# EasyEDA Pro project ProProject_Avaota Pi A_2024-03-25.epro, board 点位 (continued)
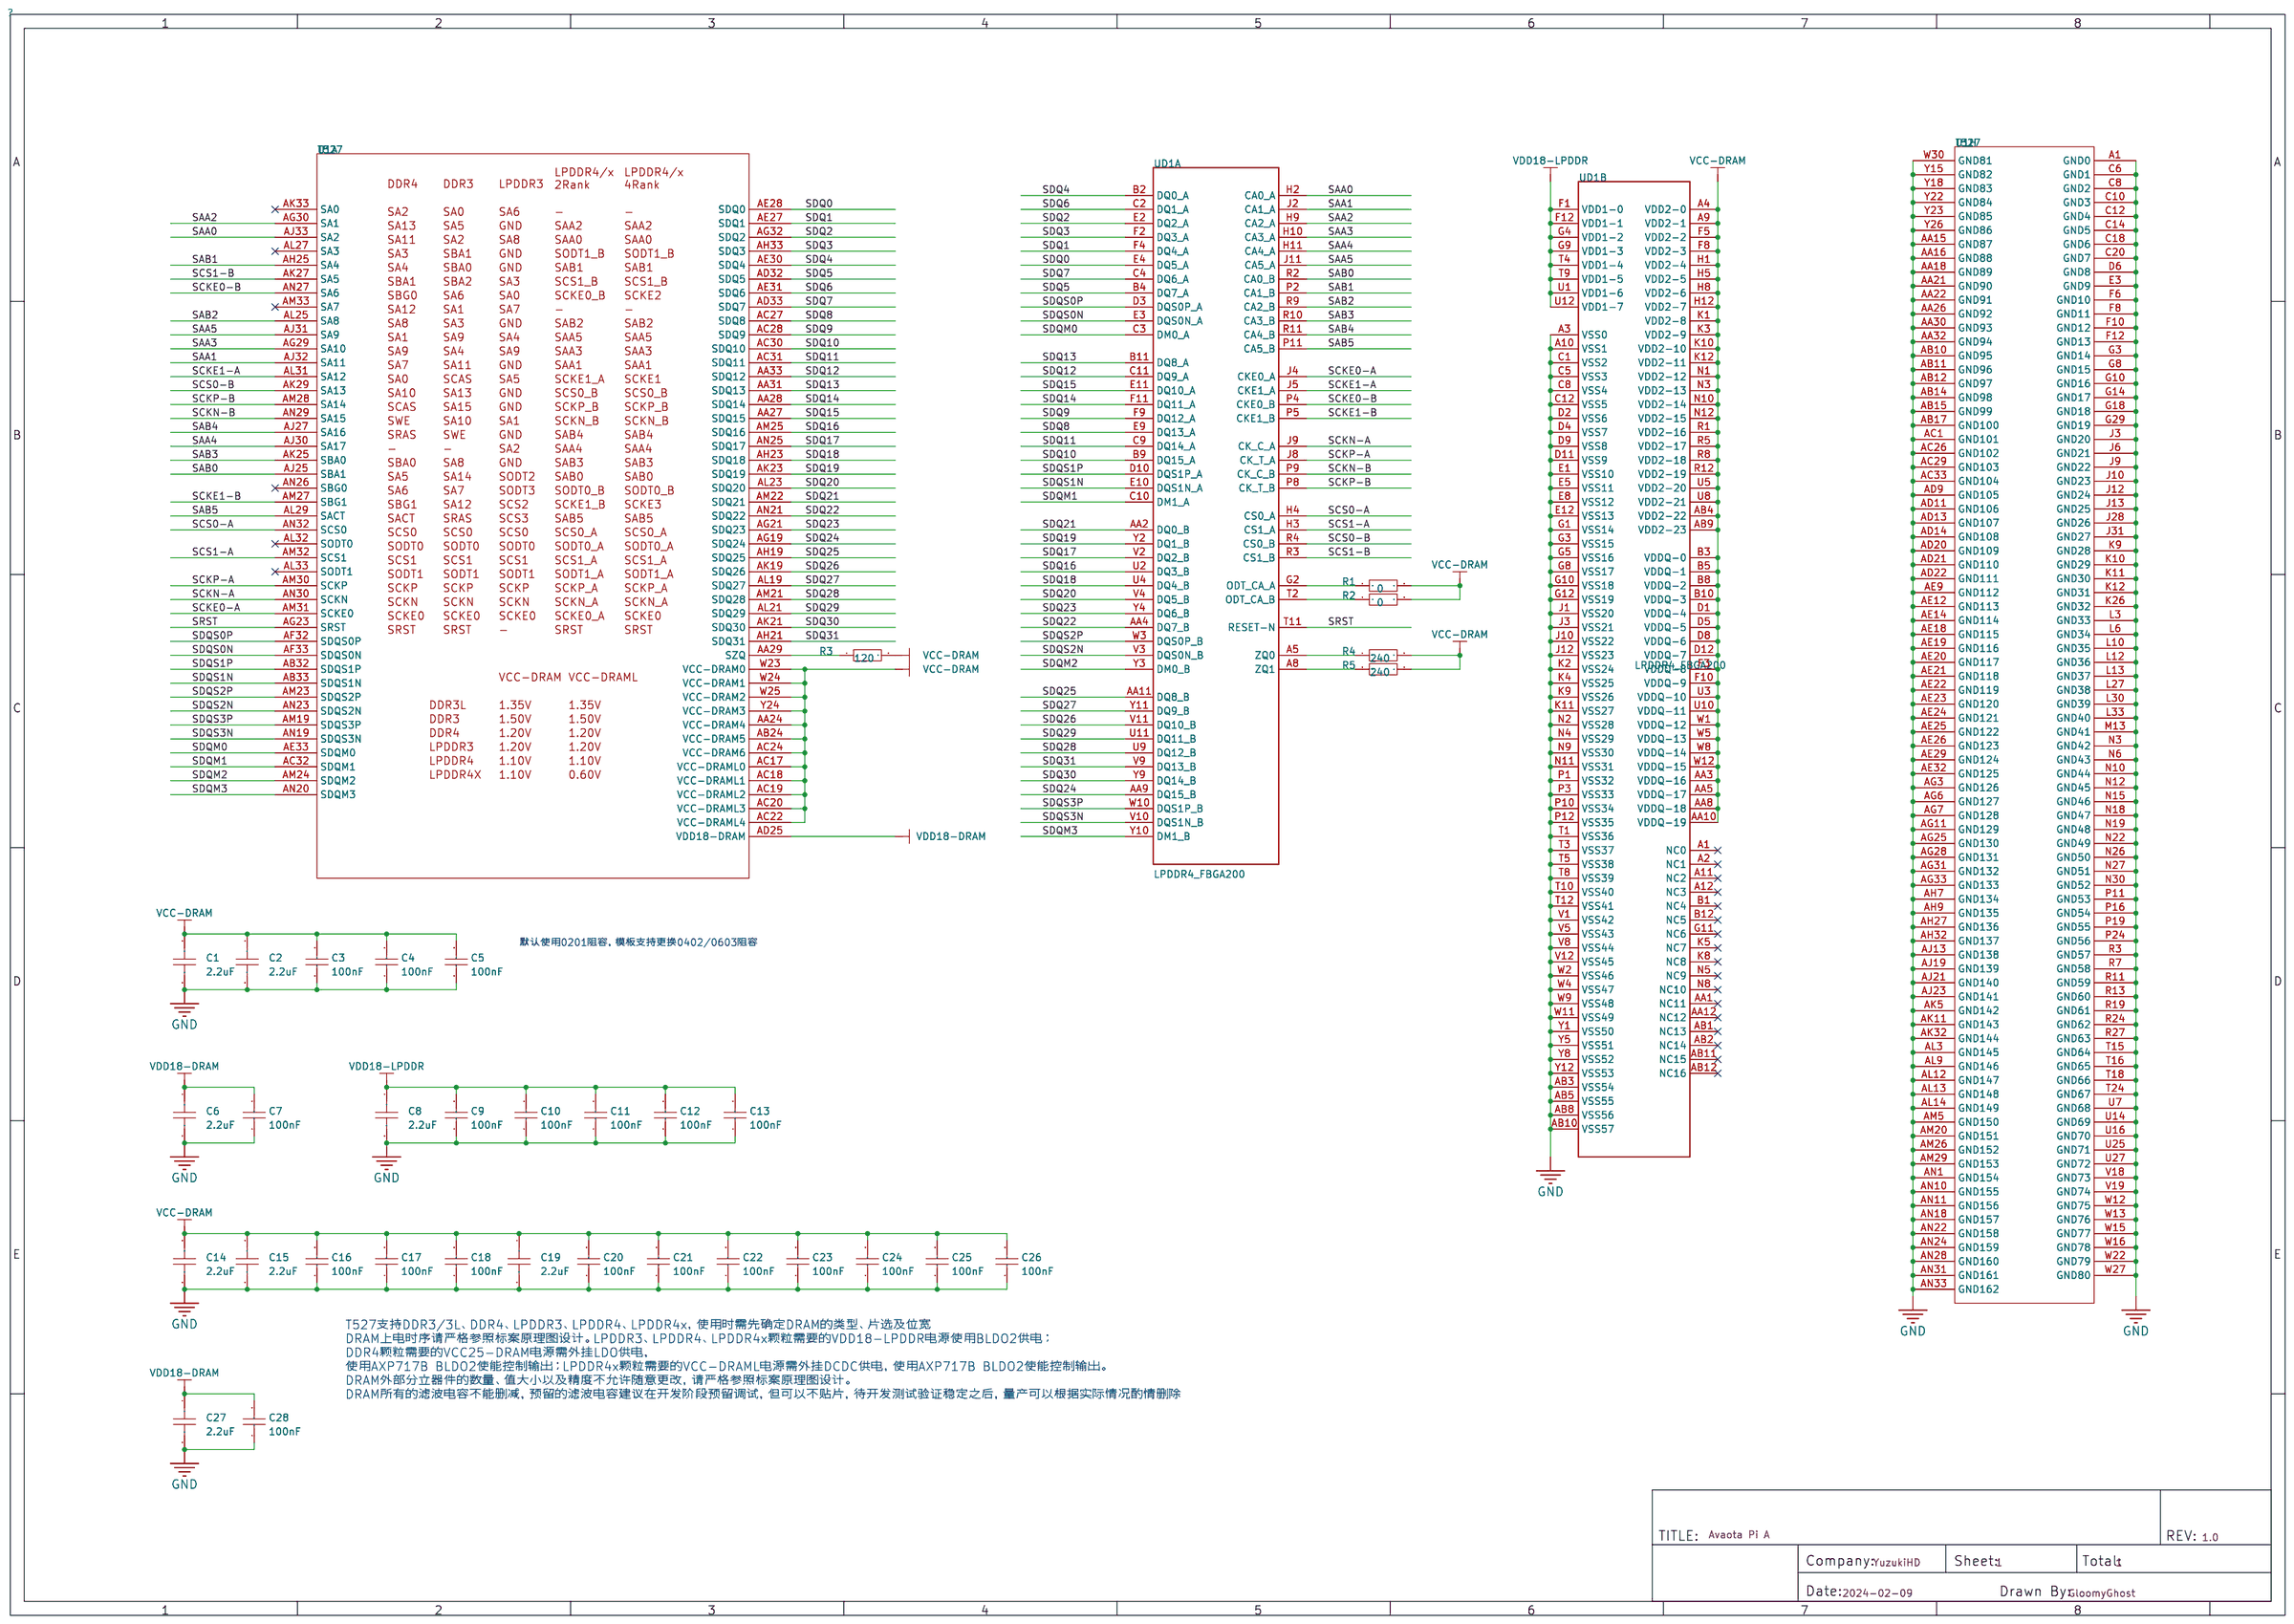
[diagram p0: schematic sheet]
## Routing (per net, layer and track width the routed paths; a pad name or vN(x,y) marks a point on that pad's centre or on a via; arc(x,y) is an arc through that point) (continued)
SAB2: length 23.2
  Top Layer w0.102: v2(36.19,49.78) 35.81,49.4
  Top Layer w0.115: v2(54.43,43.71) 54.43,44.14
  内层2 w0.115: v2(36.19,49.78) 36.54,49.43 38.71,49.43 39.24,49.96 40.36,49.96 40.46,49.86 42.15,49.86 43.33,48.68 43.33,47.27 45.24,45.36 45.63,45.36 46.9,44.09 48.66,44.09 49.05,43.71 51.2,43.71 51.47,43.98 52.26,43.98 52.45,43.79 54.36,43.79 v2(54.43,43.71)
SAB3: length 25.3
  Top Layer w0.115: v2(37.79,48.44) 37.16,49.07 35.33,49.07 35.01,49.4 ; v2(54.96,43.68) 54.96,44.11 54.93,44.14
  内层2 w0.076: 53.44,43.54 53.95,43.54 54.1,43.38 54.67,43.38 v2(54.96,43.68)
  内层2 w0.115: 53.44,43.54 53.34,43.43 52.42,43.43 52.25,43.61 51.74,43.61 51.46,43.33 48.92,43.33 48.54,43.71 46.66,43.71 45.38,45 45.08,45 42.95,47.13 42.95,48.49 41.96,49.48 40.69,49.48 40.33,49.12 40,49.12 39.65,49.48 39.22,49.48 38.78,49.05 38.4,49.05 v2(37.79,48.44)
SAB4: length 26
  Top Layer w0.102: 34.21,49.4 34.21,49.21 34.52,48.89 34.52,48.67 34.75,48.44 35.13,48.44 35.43,48.14 35.43,47.37 35.63,47.17 v2(35.63,47.14)
  Top Layer w0.115: 55.43,43.14 55.43,42.73 v2(55.47,42.7)
  Inner5 w0.076: v2(55.47,42.7) 55.14,42.37 54.15,42.37 54.07,42.44
  Inner5 w0.115: v2(35.63,47.14) 36.01,46.76 39.88,46.76 40.59,46.05 40.59,45.77 40.75,45.61 42.74,45.61 43.13,46 44.97,46 45.18,45.78 45.84,45.78 46.96,44.67 47.24,44.67 47.94,43.97 52.3,43.97 52.73,43.54 53.01,43.54 54.07,42.47 54.07,42.44
SAB5: length 27
  Top Layer w0.102: 34.21,48.75 34.21,48.67 34.49,48.39 34.49,47.12 v2(34.34,46.96)
  Top Layer w0.115: 54.43,42.14 v2(54.43,41.66)
  Inner5 w0.115: v2(34.34,46.96) 34.19,46.81 34.19,45.08 34.41,44.86 34.85,44.86 35,44.7 36.17,44.7 36.55,44.32 37.89,44.32 38.28,44.7 38.63,44.7 39.17,44.16 40.5,44.16 40.66,44.32 43.69,44.32 44.25,44.88 44.52,44.88 44.72,44.68 45.39,44.68 46.5,43.56 46.79,43.56 47.52,42.82 51.56,42.82 51.9,42.48 52.35,42.48 53.17,41.66 v2(54.43,41.66)
SCKE0-A: length 22
  Top Layer w0.076: 52.95,40.58 53.26,40.89 53.54,40.89 53.79,41.14 53.93,41.14
  Top Layer w0.115: v2(38.5,46) 38.66,45.85 39.69,45.85 39.81,45.73 39.81,45.5 ; 52.95,40.58 48.35,40.58 46.17,42.76 v2(45.75,42.76)
  内层2 w0.115: v2(38.5,46) 38.5,46.63 39.27,47.4 41.43,47.4 42.16,46.66 42.16,45.54 42.72,44.98 43.38,44.98 44.25,44.11 44.92,44.11 45.75,43.28 v2(45.75,42.76)
SCKE0-B: length 21.4
  Top Layer w0.076: 51.66,43.03 51.79,42.9 52.25,42.9 52.49,43.14
  Top Layer w0.097: 53.43,43.14 52.49,43.14
  Top Layer w0.115: v2(39.39,48.44) 39.7,48.75 39.81,48.75 ; v2(45.11,47.12) 45.03,47.12 44.22,47.93 44.22,48.15 44.38,48.31 44.57,48.31 45.87,47.02 46.45,47.02 46.89,46.58 46.89,45.29 49.15,43.03 51.66,43.03
  Inner5 w0.115: v2(45.11,47.12) 43.18,47.12 43.03,47.27 41.04,47.27 40.41,47.9 39.19,47.9 39.06,48.03 39.06,48.27 39.23,48.44 v2(39.39,48.44)
SCKE1-A: length 22.4
  Top Layer w0.076: 52.93,39.99 53.33,40.39 53.57,40.39 53.68,40.5 53.68,40.74 53.83,40.89 54.18,40.89 54.43,41.14
  Top Layer w0.102: v2(38.5,45.21) 38.78,45.49 38.98,45.49 38.99,45.5 39.01,45.5
  Top Layer w0.115: 52.93,39.99 52.86,39.99 52.85,39.98 48.11,39.98 46,42.09 45.38,42.09 45.02,42.44 45.02,42.89 44.71,43.19 44.31,43.19 v2(44.09,42.98)
  内层2 w0.115: v2(44.09,42.98) 44.09,42.99 43.7,42.99 43.23,43.46 43.23,44.02 43,44.25 42.16,44.25 41.43,44.98 40.92,44.98 40.61,45.29 40.61,46.18 40.41,46.38 40.03,46.38 39.77,46.13 39.77,45.11 39.6,44.93 39.04,44.93 38.76,45.21 v2(38.5,45.21)
SCKE1-B: length 21.8
  Top Layer w0.076: 51.55,42.72 52.32,42.72 52.57,42.97 53.14,42.97 53.22,42.89 53.68,42.89 53.93,43.14
  Top Layer w0.115: v2(45.7,46.52) 45.87,46.68 46.33,46.68 46.62,46.4 46.62,45.18 49.1,42.7 51.52,42.7 51.55,42.72 ; 39.01,48.75 38.97,48.75 v2(38.63,48.41)
  Inner5 w0.115: v2(38.63,48.41) 38.3,48.41 37.82,47.93 37.82,47.62 37.92,47.52 38.12,47.52 38.23,47.64 38.23,47.92 38.35,48.03 38.58,48.03 38.69,47.92 38.69,47.64 38.8,47.52 40.23,47.52 40.87,46.89 42.88,46.89 43.04,46.74 45.34,46.74 45.55,46.52 v2(45.7,46.52)
SCKN-A: length 21.6
  Top Layer w0.076: 35.81,45.5 36.02,45.5 36.1,45.58 36.1,46.41 36.08,46.43 36.08,46.45 ; 52.35,41.43 52.47,41.55 52.58,41.55 52.7,41.43 52.81,41.43 52.97,41.59 53.39,41.59 53.43,41.64
  Top Layer w0.127: 52.35,41.43 48.64,41.43 45.39,44.68 45.39,44.98 43.41,46.96 36.3,46.96 36.08,46.74 36.08,46.45
SCKN-B: length 21.2
  Top Layer w0.076: 36.77,47.38 36.76,47.38 36.74,47.4 36.68,47.4 36.65,47.43 36.59,47.43 36.12,47.89 36.12,48.44 35.81,48.75 ; 53.43,42.14 53.33,42.14 53.2,42.01 52.48,42.01 52.35,42.14 51.97,42.14 51.69,41.86 50.74,41.86 50.71,41.88 50.54,41.88
  Top Layer w0.127: 50.54,41.88 48.86,41.88 45.9,44.85 45.9,45.11 43.63,47.38 36.77,47.38
SCKP-A: length 21.6
  Top Layer w0.076: 53.93,41.64 53.68,41.39 53.07,41.39 52.85,41.17 52.35,41.17 ; 36.61,45.5 36.31,45.8 36.31,46.41 36.33,46.43 36.33,46.45
  Top Layer w0.127: 52.35,41.17 48.54,41.17 45.13,44.58 45.13,44.88 43.31,46.71 36.41,46.71 36.33,46.63 36.33,46.45
SCKP-B: length 21.9
  Top Layer w0.076: 36.61,48.75 36.37,48.75 36.3,48.67 36.3,48 36.67,47.63 36.77,47.63 ; 50.54,42.14 50.75,42.14 50.82,42.06 51.04,42.06 51.11,42.14 51.11,42.21 51.19,42.29 51.34,42.29 51.42,42.21 51.42,42.14 51.5,42.06 51.6,42.06 51.87,42.33 52.39,42.33 52.39,42.33 52.41,42.33 52.53,42.2 53.07,42.2 53.26,42.39 53.68,42.39 53.93,42.64
  Top Layer w0.127: 36.77,47.63 43.73,47.63 46.15,45.21 46.15,44.96 48.97,42.14 50.54,42.14
SCS0-A: length 21
  Top Layer w0.076: 53.43,40.64 53.29,40.64 52.93,40.28 52.78,40.28
  Top Layer w0.115: 52.78,40.28 48.23,40.28 46.12,42.39 45.59,42.39 45.39,42.6 45.39,43.08 v2(45.24,43.23) ; v2(39.39,45.29) 39.39,45.21 39.76,44.85 39.81,44.85
  内层2 w0.115: v2(45.24,43.23) 45.11,43.36 43.85,43.36 43.6,43.61 43.6,44.17 43.15,44.61 42.43,44.61 41.37,45.67 41.37,46.9 41.26,47.02 39.39,47.02 39.01,46.63 39.01,45.67 v2(39.39,45.29)
SCS0-B: length 23.7
  Top Layer w0.115: v2(39.39,49.1) 39.69,49.4 39.81,49.4 ; v2(54.41,42.7) 54.93,42.17 54.93,42.14
  Inner5 w0.115: v2(54.41,42.7) 54.23,42.7 53.03,43.89 52.78,43.89 52.36,44.31 48.12,44.31 47.4,45.03 47.11,45.03 46,46.15 45.34,46.15 45.12,46.37 42.88,46.37 42.79,46.47 40.7,46.47 40.03,47.14 37.62,47.14 37.41,47.35 37.41,48.62 37.62,48.82 39.11,48.82 v2(39.39,49.1)
SCS1-A: length 20.7
  Top Layer w0.076: 53.93,40.64 53.93,40.49 53.68,40.25 53.68,39.84 53,39.16 53,38.78 52.86,38.63
  Top Layer w0.115: 40.61,44.85 40.88,44.85 40.99,44.73 40.99,43.94 v2(41.02,43.92) ; v2(44.63,42.75) 44.65,42.72 44.65,42.29 45.21,41.73 45.84,41.73 47.9,39.67 51.99,39.67 52.27,39.4 52.27,38.84 52.47,38.63 52.86,38.63
  Inner5 w0.115: v2(44.63,42.75) 44.74,42.75 44.85,42.86 44.85,43.24 44.74,43.36 43.9,43.36 43.79,43.47 43.79,43.85 43.67,43.97 43.44,43.97 43.33,43.85 43.33,43.36 43.22,43.24 42.94,43.24 42.72,43.46 42.56,43.46 42.44,43.57 42.44,43.84 42.36,43.92 42.11,43.92 42,43.8 42,43.7 41.88,43.59 41.66,43.59 41.54,43.7 41.54,43.8 41.43,43.92 v2(41.02,43.92)
SCS1-B: length 22.5
  Top Layer w0.102: 54.93,43.14 54.93,42.7 v2(54.94,42.7)
  Top Layer w0.115: v2(40.92,49.07) 40.92,49.09 40.61,49.4
  Inner5 w0.115: v2(40.92,49.07) 40.76,49.07 40.61,48.92 40.61,48.21 41.07,47.75 43.06,47.75 43.32,47.5 45.24,47.5 46.81,45.92 47.48,45.92 47.64,45.77 47.64,45.32 48.3,44.65 48.42,44.65 48.53,44.77 48.53,44.94 48.65,45.06 48.88,45.06 48.99,44.94 48.99,44.77 49.1,44.65 49.33,44.65 49.45,44.77 49.45,44.98 49.56,45.09 49.79,45.09 49.91,44.98 49.91,44.77 50.02,44.65 50.25,44.65 50.36,44.77 50.36,44.94 50.48,45.06 50.7,45.06 50.82,44.94 50.82,44.77 50.93,44.65 51.16,44.65 51.28,44.77 51.28,44.94 51.39,45.06 51.62,45.06 51.73,44.94 51.73,44.77 51.85,44.65 52,44.65 52.12,44.77 52.12,44.97 52.24,45.09 52.4,45.09 52.53,44.97 52.53,44.6 52.73,44.4 53.16,44.4 53.29,44.27 53.29,44.14 53.39,44.04 53.61,44.04 53.72,43.93 53.72,43.59 54.25,43.05 55.01,43.05 55.12,42.95 55.12,42.79 55.02,42.7 v2(54.94,42.7)
SDC0-CLK: length 39.7
  Top Layer w0.102: R42.2 73.14,47.07 87.22,47.07 89.69,49.53 93.32,49.53 93.62,49.23 95.66,49.23 96.22,48.67 96.22,48.46 96.11,48.36 95.91,48.36 95.45,48.82 v3(94.77,48.82)
  Bottom Layer w0.102: v3(94.77,48.82) 94.77,50.3 D19.2 95.58,52.03 95.58,55.58 96.37,56.36 96.37,57.33 97.84,58.8 97.84,59.21 98.54,59.91 SIM1.5
SDC0-CMD: length 39.6
  Top Layer w0.076: 68.95,47.12 69.09,47.12 69.15,47.06 70.37,47.06 70.69,47.38 71.87,47.38
  Top Layer w0.102: 71.87,47.38 71.88,47.37 87.12,47.37 89.59,49.84 93.55,49.84 93.85,49.53 95.83,49.53 v3(96.6,48.77)
  Bottom Layer w0.102: v3(96.6,48.77) 96.6,50.3 D21.2 96.65,51.27 96.65,54.99 97.36,55.7 97.36,56.49 98.58,57.71 SIM1.3
SDC0-D0: length 41.8
  Top Layer w0.076: 69.44,46.64 69.51,46.71 70.53,46.71 70.84,47.02 71.51,47.02 71.7,46.84 72.14,46.84 72.34,46.63 72.54,46.63
  Top Layer w0.102: 72.54,46.63 73.33,46.63 73.46,46.76 87.35,46.76 89.81,49.23 93.14,49.23 93.55,48.82 v3(93.83,48.82)
  Bottom Layer w0.102: SIM1.7 98.59,62.11 97.18,60.71 97.18,58.8 95.88,57.51 95.88,56.57 95.1,55.78 95.1,52.51 D18.1 93.83,50.29 v3(93.83,48.82)
SDC0-D1: length 42.9
  Top Layer w0.076: 72.52,46.41 72.21,46.41 71.98,46.63 71.53,46.63 71.33,46.83 70.93,46.83 70.63,46.54 69.73,46.54 69.58,46.38 69.35,46.38 69.09,46.64 69.09,46.64 68.94,46.64
  Top Layer w0.102: v3(92.86,48.82) 92.76,48.92 89.97,48.92 87.53,46.48 73.61,46.48 73.53,46.41 72.52,46.41
  Bottom Layer w0.102: SIM1.8 98.52,63.21 97.76,62.46 97.76,62 96.7,60.93 96.7,58.93 95.48,57.71 95.48,56.82 94.61,55.96 94.61,52.97 D17.2 92.86,50.3 v3(92.86,48.82)
SDC0-D2: length 38.9
  Top Layer w0.076: 69.44,47.64 69.76,47.64 70.05,47.93 70.51,47.93 70.61,47.83 71.53,47.83 71.6,47.9
  Top Layer w0.102: v3(98.48,48.82) 98.09,49.2 97.66,49.2 97.33,49.53 96.82,49.53 96.24,50.11 94.31,50.11 93.95,50.47 89.26,50.47 86.69,47.9 71.6,47.9
  Bottom Layer w0.102: v3(98.48,48.82) 98.48,50.25 D23.2 97.49,51.24 97.49,54.69 98.31,55.51 SIM1.1
SDC0-D3: length 39.4
  Top Layer w0.076: 68.94,47.64 69.06,47.64 69.31,47.39 69.75,47.39 70.1,47.74 70.42,47.74 70.59,47.57 71.58,47.57 71.65,47.65
  Top Layer w0.102: 71.65,47.65 86.89,47.65 89.38,50.14 93.73,50.14 94.06,49.81 96.01,49.81 96.62,49.2 97.13,49.2 v3(97.51,48.82)
  Bottom Layer w0.102: SIM1.2 98.74,56.54 98.45,56.54 97.74,55.83 97.74,55.52 97.08,54.86 D22.1 97.51,50.33 v3(97.51,48.82)
SDC0-DET: length 29
  Top Layer w0.102: v3(73.81,46.13) 73.86,46.18 87.71,46.18 90.14,48.62 91.87,48.62 v1(91.97,48.51) ; U14.D20 v3(67.94,47.18)
  Bottom Layer w0.102: v3(73.81,46.13) 72.01,46.13 71.17,46.96 70.79,46.96 70.69,46.86 68.26,46.86 v3(67.94,47.18)
  Bottom Layer w0.127: v1(91.97,48.51) 91.82,48.67 91.01,48.67 90.7,48.97 90.7,50.33
SDC1-CLK: length 48
  Top Layer w0.102: R43.2 62.99,60.48 61.82,61.65 55.75,61.65 54.05,59.94 34.09,59.94 27,52.86 22.45,52.86 21.56,53.75 21.56,54.76
SDC1-CMD: length 53.2
  Top Layer w0.076: 62.44,55.64 62.44,55.79 62.71,56.06 62.71,57.78 63.27,58.34 63.27,58.5
  Top Layer w0.102: 63.27,58.5 63.35,58.57 63.35,60.53 61.93,61.95 55.6,61.95 53.9,60.25 33.86,60.25 26.75,53.14 22.94,53.14 v3(22.53,53.54) ; v3(21.01,53.8) 20.66,54.14 20.66,54.76
  Bottom Layer w0.102: v3(21.01,53.8) 22.28,53.8 v3(22.53,53.54)
SDC1-D0: length 52.3
  Top Layer w0.076: 62.94,55.14 62.69,55.39 62.69,55.78 62.87,55.96 62.87,57.69 63.6,58.42 63.6,58.44
  Top Layer w0.102: 63.6,58.44 63.68,58.52 63.68,60.63 62.05,62.26 55.42,62.26 53.75,60.58 33.66,60.58 26.54,53.47 23.42,53.47 22.46,54.42 22.46,54.76
SDC1-D1: length 51.3
  Top Layer w0.076: 62.94,55.64 63.04,55.74 63.04,57.57 63.96,58.5 63.96,58.55
  Top Layer w0.102: 23.36,54.76 23.36,54.12 23.66,53.82 26.42,53.82 33.5,60.91 53.59,60.91 55.25,62.56 62.2,62.56 63.96,60.81 63.96,58.55
SDC1-D2: length 54.3
  Top Layer w0.076: 61.94,55.14 61.69,55.39 61.69,55.77 61.85,55.93 61.85,56.35 61.7,56.5 61.68,56.82 61.63,57.2 61.66,57.54 61.84,57.86 61.99,58.2
  Top Layer w0.102: 61.98,58.19 62.36,58.57 62.36,60.3 61.59,61.06 56.13,61.06 54.41,59.33 34.54,59.33 27.48,52.27 21.03,52.27 18.86,54.44 18.86,54.76
SDC1-D3: length 53.3
  Top Layer w0.076: 61.94,55.64 62.03,55.74 62.03,56.5 61.87,56.66 61.87,57.02 61.87,57.31 61.99,57.65 62.22,58.05
  Top Layer w0.102: 62.23,58.06 62.66,58.5 62.66,60.43 61.72,61.37 55.96,61.37 54.23,59.64 34.29,59.64 27.2,52.55 21.49,52.55 19.76,54.28 19.76,54.76
SDC2-CLK: length 25.7
  Top Layer w0.102: U8.M6 37.17,33.44 37.38,33.64 v3(37.68,33.64) ; R41.1 58.82,37.54 58.37,37.54 58.27,37.44 40.97,37.44 40.26,36.73 39.7,36.73 v3(39.52,36.55)
  Bottom Layer w0.102: v3(37.68,33.64) 37.31,34.01 37.31,34.29 37.59,34.57 38.05,34.57 39.97,36.49 39.97,36.64 39.85,36.75 39.73,36.75 v3(39.52,36.55)
SDC2-CMD: length 27.8
  Top Layer w0.076: 60.49,37.99 60.57,38.31 60.54,39.12 60.54,39.53 60.53,39.84 60.46,40.02 60.41,40.13
  Top Layer w0.102: U8.M5 37.17,33.89 37.42,34.14 v3(37.68,34.14) ; 60.5,37.99 60.17,37.67 60.17,37.36 59.77,36.96 58.7,36.96 58.6,36.86 41.91,36.86 v3(41.55,36.5)
  Bottom Layer w0.102: v3(37.68,34.14) 37.87,34.14 38.18,33.83 38.48,33.83 38.86,34.22 38.86,34.42 40.51,36.07 40.74,36.07 41.15,36.47 41.15,36.5 v3(41.55,36.5)
SDC2-D0: length 23
  Top Layer w0.076: 60.94,40.6 60.99,40.48 61.02,40.44 61.02,39.96 61.09,39.77 61.11,39.22 61.17,38.34 61.18,38.03 61.12,37.66 61.11,37.43
  Top Layer w0.102: U8.A3 44.08,34.89 44.93,35.74 59.08,35.74 59.41,36.07 60.2,36.07 61.01,36.88 61.01,37.29 61.12,37.42
SDC2-D1: length 24.1
  Top Layer w0.076: 61.6,37.39 61.5,39.17 61.5,39.78 61.68,40.01 61.69,40.29 61.44,40.54 U14.U32
  Top Layer w0.102: U8.A4 44.65,34.39 45.31,35.05 59.54,35.05 59.84,35.36 60.43,35.36 61.61,36.54 61.61,37.38
SDC2-D2: length 25
  Top Layer w0.076: 61.94,40.65 62.02,40.57 62.02,40.41 62.02,39.81 61.92,39.64 61.95,38.25 62.13,37.67 62.13,37.54
  Top Layer w0.102: 62.13,37.54 62.12,37.53 62.12,36.03 60.81,34.72 60.17,34.72 59.87,34.42 45.85,34.42 45.31,33.88 42.68,33.88 U8.A5
SDC2-D3: length 24.6
  Top Layer w0.076: 60.67,37.72 60.78,38.31 60.76,38.66 60.73,39.67 60.69,39.86 ; 60.44,40.65 60.44,40.55 60.69,40.3 60.69,39.86
  Top Layer w0.102: U8.B2 42.42,35.64 42.85,35.64 43.1,35.38 43.61,35.38 43.97,35.74 43.97,35.87 43.84,35.99 43.33,35.99 43.19,36.14 43.19,36.28 43.33,36.42 58.64,36.42 58.87,36.65 59.89,36.65 60.45,37.21 60.45,37.51 60.67,37.72
SDC2-D4: length 23.8
  Top Layer w0.076: 60.88,37.77 60.99,38.24 60.96,38.58 60.93,39.74 60.86,39.93 60.86,40.38 60.69,40.54 60.69,40.9 60.44,41.15
  Top Layer w0.102: 60.88,37.77 60.88,37.58 60.73,37.43 60.73,37.06 60.05,36.37 59.13,36.37 58.85,36.09 44.75,36.09 43.79,35.13 42.41,35.13 U8.B3
SDC2-D5: length 24.7
  Top Layer w0.076: 60.94,41.15 61.19,40.9 61.19,40.04 61.26,39.86 61.26,39.86 61.36,38.48 61.36,38.24 61.34,37.46
  Top Layer w0.102: U8.B4 42.43,34.65 44.37,34.65 45.11,35.38 59.26,35.38 59.61,35.74 60.32,35.74 61.34,36.75 61.34,37.47
SDC2-D6: length 25.8
  Top Layer w0.076: 61.44,41.15 61.7,40.9 61.7,40.52 61.85,40.36 61.84,39.95 61.74,39.82 61.69,39.73 61.69,39.17 61.75,38.19 61.81,37.56 61.87,37.48
  Top Layer w0.102: 61.88,37.47 61.88,36.3 60.63,35.05 60,35.05 59.66,34.72 45.57,34.72 44.98,34.14 42.42,34.14 U8.B5
SDC2-D7: length 26.7
  Top Layer w0.076: 61.94,41.15 62.19,40.91 62.19,39.71 62.12,39.56 62.15,38.31 62.35,37.56
  Top Layer w0.102: 62.36,37.57 62.43,37.49 62.43,35.89 60.99,34.44 60.4,34.44 60.05,34.09 46.05,34.09 45.59,33.63 42.41,33.63 U8.B6
SDC2-DS: length 27.9
  Top Layer w0.127: U8.H5 39.55,34.27 v3(39.55,34.34) ; U14.W28 v3(60.81,42.64)
  内层4 w0.127: v3(60.81,42.64) 60.81,38.86 56.29,34.34 v3(39.55,34.34)
SDC2-RST: length 27.4
  Top Layer w0.076: 60.36,38.31 60.36,39.73 60.19,39.9 60.19,40.9 59.94,41.15
  Top Layer w0.102: v3(38.41,34.24) 38.17,34.01 U8.K5 ; v3(40.59,36.5) 41.22,37.14 58.42,37.14 58.52,37.24 59.61,37.24 59.89,37.52 59.89,37.72 60.33,38.19 60.36,38.32
  Bottom Layer w0.102: v3(40.59,36.5) 40.44,36.5 38.41,34.47 v3(38.41,34.24)
SDQ0: length 21.9
  Top Layer w0.115: 39.81,42.9 39.67,42.9 39.37,43.21 v2(39.37,43.23) ; v2(57.02,42.7) 57.37,42.7 57.43,42.64
  内层2 w0.115: v2(39.37,43.23) 39.42,43.23 39.7,42.95 41.04,42.95 41.63,42.37 41.96,42.37 42.19,42.14 42.19,41.76 42.86,41.08 51.12,41.08 51.53,40.68 53.83,40.68 54.09,40.43 56.2,40.43 56.56,40.79 56.56,42.25 v2(57.02,42.7)
SDQ1: length 21.4
  Top Layer w0.076: 57.43,43.14 57.12,43.14 v2(57.05,43.21)
  Top Layer w0.115: v2(40.22,43.81) 40.2,43.81 40.18,43.79 40.05,43.79 39.81,43.55
  内层2 w0.076: 55.88,40.69 55.8,40.61 54.33,40.61 54.25,40.69
  内层2 w0.115: 55.88,40.69 56.13,40.69 56.34,40.89 56.34,42.52 57.03,43.21 v2(57.05,43.21) ; 54.25,40.69 53.94,41.01 51.67,41.01 51.18,41.5 43.63,41.5 43.41,41.73 43.41,42.16 42.89,42.68 42.23,42.68 42.18,42.74 41.77,42.74 41.17,43.33 40.7,43.33 v2(40.22,43.81)
SDQ2: length 22.4
  Top Layer w0.115: 56.43,40.64 56.43,40.67 v2(55.98,41.12) ; v2(43.81,41.96) 43.89,41.96 44.83,41.02 45.54,41.02 45.77,40.79 45.77,40.56 45.59,40.39 45.01,40.39 43.81,41.58 43.66,41.58 43.41,41.83 43.41,42.12 43.18,42.34 43.05,42.34 42.81,42.58 41.72,42.58 41.41,42.9
  内层2 w0.076: 54.53,40.84 54.58,40.79 55.65,40.79 v2(55.98,41.12)
  内层2 w0.115: v2(43.81,41.96) 43.84,41.94 51.38,41.94 51.94,41.38 53,41.38 53.12,41.49 53.12,41.69 53.23,41.81 53.46,41.81 53.57,41.69 53.57,41.49 53.69,41.38 54,41.38 54.53,40.84
SDQ3: length 21.4
  Top Layer w0.076: 55.93,40.14 55.7,39.9 55.02,39.9 54.69,39.57 54.48,39.57 v2(53.92,39.01)
  Top Layer w0.115: 41.41,43.55 41.72,43.87 42.29,43.87 42.95,43.21 42.95,42.82 43.06,42.71 43.18,42.71 43.39,42.49 43.87,42.49 45.02,41.35 45.74,41.35 46.12,40.97 46.12,40.39 45.79,40.06 44.8,40.06 44.68,39.93 44.68,39.65 44.8,39.52 45.34,39.52 45.49,39.37 45.49,39.06 v2(45.44,39.01)
  内层2 w0.115: v2(45.44,39.01) 45.81,38.64 53.55,38.64 v2(53.92,39.01)
SDQ4: length 18.8
  Top Layer w0.115: v2(44.04,40.29) 43.68,39.93 43,39.93 42.31,40.61 41.74,40.61 41.41,40.95 ; 57.43,41.64 57.9,41.64 v2(57.94,41.68)
  内层2 w0.115: v2(57.94,41.68) 57.83,41.68 57.43,41.27 57.43,40.69 56.69,39.95 53.57,39.95 53.49,40.03 50.7,40.03 50.49,40.23 44.1,40.23 v2(44.04,40.29)
SDQ5: length 21.1
  Top Layer w0.076: v2(57.14,39) 57.55,39.42 57.55,39.91 57.68,40.04 57.68,40.39 57.93,40.64
  Top Layer w0.115: 39.81,40.95 40.11,40.64 40.16,40.64 40.17,40.62
  内层2 w0.115: v2(57.14,39) 57.14,38.95 55.99,37.8 43.2,37.8 40.42,40.58 40.22,40.58 v2(40.17,40.62)
SDQ6: length 20.8
  Top Layer w0.115: v2(43.36,40.29) 43.51,40.29 43.89,40.67 43.89,41.15 43.79,41.25 43.66,41.25 43.58,41.17 43.58,40.73 43.51,40.66 43.34,40.66 43.25,40.74 43.25,41.13 43.14,41.25 43.01,41.25 42.9,41.13 42.9,40.74 42.82,40.67 42.67,40.67 42.57,40.77 42.57,41.08 42.4,41.25 41.75,41.25 41.41,41.6 ; 57.43,41.14 57.4,41.1 v2(56.97,41.1)
  内层2 w0.115: v2(56.97,41.1) 56.97,40.74 56.41,40.18 53.92,40.18 53.77,40.33 51.28,40.33 50.95,40.67 43.73,40.67 v2(43.36,40.29)
SDQ7: length 23.5
  Top Layer w0.076: 57.93,40.14 57.86,40.07 57.86,39.96 57.76,39.86 57.76,39.24 57.65,39.13 v2(57.65,39)
  Top Layer w0.115: 39.81,41.6 39.74,41.6 v2(39.44,41.3)
  内层2 w0.115: v2(57.65,39) 57.65,38.85 56.18,37.38 41.79,37.38 39.5,39.67 39.5,40 39.77,40.28 39.77,40.97 v2(39.44,41.3)
SDQ8: length 28.1
  Top Layer w0.115: v2(58.85,42.88) 58.69,42.88 58.43,43.14 ; UD1.E9 36.35,42.57 36.8,42.57 37.16,42.52 37.49,42.57 v2(37.77,42.87)
  Inner5 w0.115: v2(37.77,42.87) 38.22,43.33 38.68,43.33 39.14,42.87 39.77,42.87 39.85,42.95 40.63,42.95 40.74,43.07 40.74,43.34 40.85,43.46 41.08,43.46 41.2,43.34 41.2,42.93 41.68,42.44 42.19,42.44 42.36,42.62 42.98,42.62 43.09,42.51 43.09,42.43 43.21,42.32 43.44,42.32 43.55,42.43 43.55,42.51 43.67,42.62 43.91,42.62 44.22,42.32 46.25,42.32 46.97,41.6 51.51,41.6 52.35,40.76 56.38,40.76 56.51,40.89 56.51,41.76 56.82,42.06 58.11,42.06 58.34,42.29 58.34,42.77 58.46,42.88 v2(58.85,42.88)
SDQ9: length 28.1
  Top Layer w0.115: 35.81,43.55 35.89,43.46 36.23,43.46 36.46,43.23 37.95,43.23 38.17,43 38.17,42.32 v2(38.56,41.94) ; v2(58.82,42.36) 58.72,42.36 58.43,42.64
  Inner5 w0.115: v2(38.56,41.94) 38.56,42.15 38.67,42.27 39.62,42.27 40.16,41.73 40.99,41.73 41.81,40.92 41.81,40.78 41.92,40.67 42.47,40.67 42.95,41.15 44.06,41.15 44.47,41.55 45.38,41.55 45.49,41.44 45.49,41.3 45.62,41.17 45.74,41.17 45.98,41.41 46.14,41.41 46.78,40.77 51.46,40.77 51.92,40.31 57.68,40.31 58.29,40.92 58.29,41.68 58.82,42.21 v2(58.82,42.36)
SDQ10: length 26.9
  Top Layer w0.076: v2(58.9,41.64) 58.44,41.64 58.43,41.64
  Top Layer w0.115: 35.81,40.95 36.14,40.61 36.7,40.61 37.06,40.26 37.56,40.26 v2(37.87,40.56)
  Inner5 w0.115: v2(58.9,41.64) 58.83,41.64 58.52,41.33 58.52,40.61 57.99,40.08 51.56,40.08 51.29,40.35 46.7,40.35 46.32,40.73 45.26,40.73 45.15,40.84 45.15,41.06 45.03,41.17 44.81,41.17 44.69,41.06 44.69,40.84 44.58,40.73 43.12,40.73 42.68,40.28 41.54,40.28 41.43,40.4 41.43,40.74 41.25,40.92 40.64,40.92 40.59,40.97 39.7,40.97 39.65,40.92 37.98,40.92 37.87,40.8 v2(37.87,40.56)
SDQ11: length 26.1
  Top Layer w0.115: 58.43,41.14 58.47,41.1 v2(58.9,41.1) ; v2(38.53,40.56) 38.15,40.94 37.59,40.94 37.28,41.25 36.15,41.25 35.81,41.6
  Inner5 w0.115: v2(38.53,40.56) 38.81,40.56 38.92,40.45 38.92,40.32 39.29,39.96 39.45,39.96 39.7,40.21 40.74,40.21 41.02,39.93 44.37,39.93 44.47,40.03 44.47,40.27 44.59,40.38 44.91,40.38 45.08,40.21 45.51,40.21 45.62,40.31 46.14,40.31 46.25,40.2 46.25,40.03 46.35,39.93 51.14,39.93 51.21,39.85 58.14,39.85 58.9,40.61 v2(58.9,41.1)
SDQ12: length 32.7
  Top Layer w0.115: 34.21,41.6 33.71,41.1 33.71,40.18 v2(33.3,39.78) ; v2(59.5,39.57) 59.43,39.64 59.43,40.14
  Inner5 w0.115: v2(59.5,39.57) 59.76,39.57 60.22,39.12 60.22,38.76 59.84,38.38 59.84,38.12 59.09,37.38 35.7,37.38 v2(33.3,39.78)
SDQ13: length 31.5
  Top Layer w0.076: 59.27,39.31 59.42,39.25 v2(59.83,38.94) ; 59.27,39.31 59.13,39.45 59.13,39.7 59.18,39.75 59.18,40.89 59.43,41.14 ; 59.27,39.31 arc(59.27,39.31) 59.27,39.3
  Top Layer w0.115: v2(34.19,39.78) 33.91,40.05 33.91,40.65 34.21,40.95
  Inner5 w0.115: v2(34.19,39.78) 34.19,39.4 35.79,37.79 59.1,37.79 59.54,38.23 59.54,38.46 59.83,38.75 v2(59.83,38.94)
SDQ14: length 32.5
  Top Layer w0.102: v2(59.9,42.65) 59.89,42.64 59.43,42.64
  Top Layer w0.115: 34.21,43.55 34.21,43.51 v2(33.88,43.18)
  Inner5 w0.115: 33.88,43.18 34.14,42.93 34.85,42.93 34.93,43.01 35.48,43.01 36.19,42.29 36.19,40.79 37.89,39.09 44.98,39.09 45.29,39.4 45.59,39.4 45.9,39.09 52.19,39.09 52.5,39.4 58.62,39.4 59.54,40.31 59.54,42.29 v2(59.9,42.65)
SDQ15: length 31.8
  Top Layer w0.115: 59.43,43.14 59.47,43.18 v2(59.94,43.18) ; v2(34.62,43.28) 34.59,43.28 34.21,42.9
  Inner5 w0.115: v2(59.94,43.18) 59.84,43.18 59.26,42.6 59.26,40.46 58.42,39.62 52.19,39.62 52.08,39.51 46.07,39.51 45.76,39.81 45.11,39.81 44.8,39.5 38.02,39.5 36.6,40.92 36.6,42.34 35.66,43.28 v2(34.62,43.28)
SDQ16: length 16.7
  Top Layer w0.076: 51.91,43.57 52.91,43.57 53.23,43.89 53.68,43.89 53.93,44.14
  Top Layer w0.115: v2(47.27,45.47) 49.27,43.46 51.79,43.46 51.91,43.57 ; UD1.U2 41.71,50.95 41.73,50.98 42.32,51 42.6,50.9 42.85,50.95 43.08,50.85 43.13,50.75 43.26,50.57 v2(43.38,50.22)
  内层2 w0.115: v2(47.27,45.47) 47.27,45.48 46.04,46.71 46.04,47.64 43.46,50.22 v2(43.38,50.22)
SDQ17: length 16.5
  Top Layer w0.115: 53.43,44.14 53.13,44.14 52.88,43.89 51.86,43.89 51.69,43.71 49.58,43.71 48.03,45.26 48.03,45.44 v2(48,45.47) ; v2(43.33,51.36) 43,51.69 41.74,51.69 41.41,51.35
  内层2 w0.115: v2(43.33,51.36) 43.33,50.94 46.45,47.81 46.45,46.89 47.88,45.47 v2(48,45.47)
SDQ18: length 24.1
  Top Layer w0.076: 55.93,45.14 55.93,44.75 v2(56.01,44.68)
  Top Layer w0.115: v2(39.4,51.08) 39.78,50.7 39.81,50.7
  内层2 w0.115: v2(39.4,51.08) 39.14,51.34 39.14,53.14 39.39,53.39 46.2,53.39 51.46,48.13 51.84,48.13 53.62,46.35 53.62,45.97 54.29,45.3 55.54,45.3 56.01,44.83 v2(56.01,44.68)
SDQ19: length 18.9
  Top Layer w0.115: 54.93,45.14 54.96,45.11 v2(54.96,44.68) ; 41.41,52.65 41.54,52.65 41.85,52.96 43.25,52.96 43.72,52.49 43.72,51.36 43.97,51.12 46.06,51.12 v2(46.73,51.79)
  内层2 w0.115: v2(46.73,51.79) 46.73,51.78 50.2,48.31 50.54,48.31 53.36,45.49 53.49,45.49 53.92,45.06 54.68,45.06 54.96,44.78 v2(54.96,44.68)
SDQ20: length 21.2
  Top Layer w0.076: v2(39.5,52.98) 39.5,51.66 39.81,51.35
  Top Layer w0.102: 54.43,45.14 v2(54.43,44.68)
  内层2 w0.115: v2(54.43,44.68) 53.92,44.68 53.36,45.24 53.02,45.24 50.34,47.92 50.01,47.92 46.31,51.61 46.31,52.59 45.9,53.01 39.52,53.01 v2(39.5,52.98)
SDQ21: length 17.3
  Top Layer w0.076: v2(51.97,45.47) 52.3,45.8 53.21,45.8 53.31,45.89 53.68,45.89 53.93,45.64
  Top Layer w0.115: 41.41,53.3 41.49,53.3 41.91,53.72 41.91,54.05 42.11,54.25 42.44,54.25 42.85,53.85 43.63,53.85 45.62,51.87 45.73,51.87 45.84,51.75 v2(45.84,51.66)
  内层2 w0.115: v2(45.84,51.66) 45.84,51.48 49.83,47.5 50.11,47.5 51.97,45.64 v2(51.97,45.47)
SDQ22: length 20.7
  Top Layer w0.076: 53.43,46.14 53.3,46.14 53.15,45.99 51.6,45.99
  Top Layer w0.115: v2(45.82,52.55) 45.41,52.55 43.74,54.23 43.56,54.23 42.8,54.99 40.64,54.99 40.16,54.51 40.16,53.65 39.81,53.3 ; 51.6,45.99 51.46,45.85 51.46,45.49 51.43,45.47 v2(51.38,45.47)
  内层2 w0.115: v2(45.82,52.55) 45.43,52.16 45.43,51.31 49.66,47.08 49.94,47.08 51.38,45.63 v2(51.38,45.47)
SDQ23: length 22.2
  Top Layer w0.102: 56.43,46.14 56.43,45.89 ; 56.43,45.89 56.43,46.14 ; 56.43,45.89 56.43,45.82 56.53,45.72 v2(56.55,45.72)
  Top Layer w0.115: 39.81,52.65 40,52.65 40.31,52.96 40.71,52.96 40.99,53.24 40.99,53.31 41.3,53.62 41.5,53.62 41.7,53.82 41.7,54.15 42.11,54.56 42.59,54.56 42.69,54.46 v2(42.82,54.46)
  内层2 w0.115: v2(56.55,45.72) 56.12,46.15 54.4,46.15 51.97,48.59 51.59,48.59 45.72,54.46 v2(42.82,54.46)